# EAGLE schematic MCS (EAGLE 6.5.0)

## Sheet 1 of 3
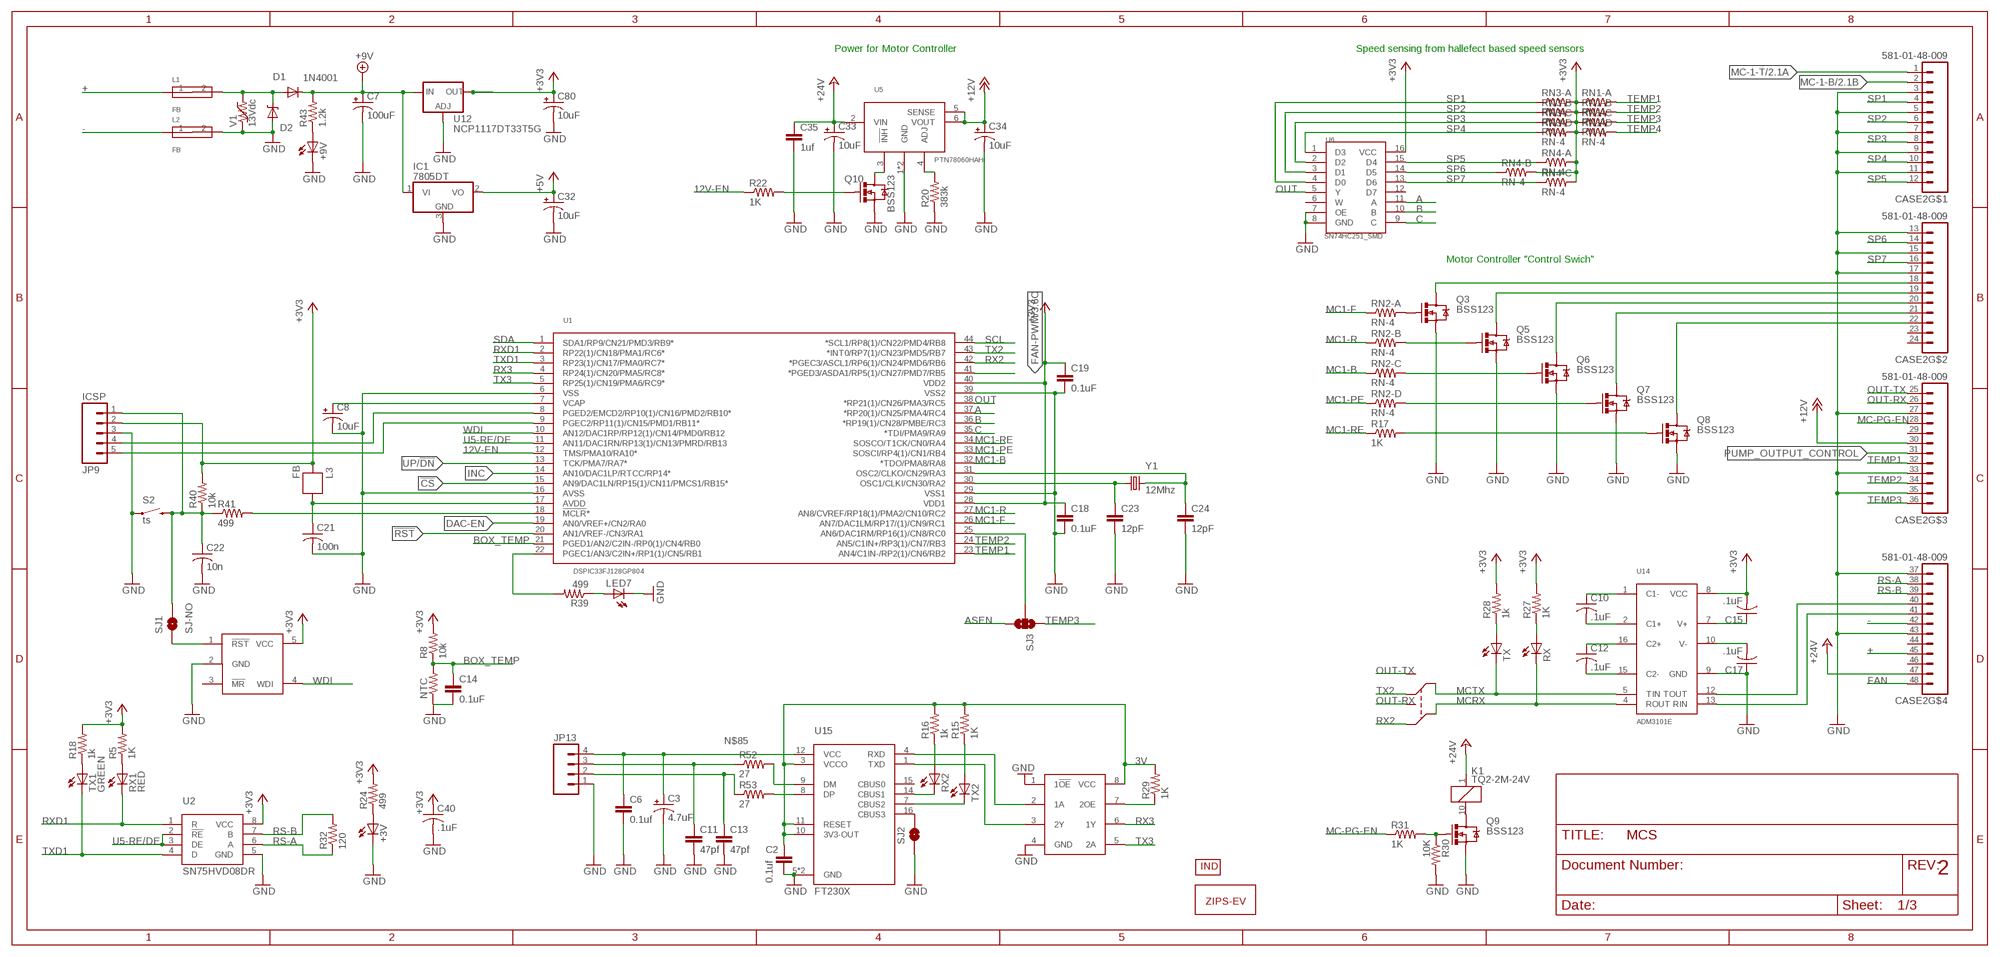
[diagram p0: schematic, sheet 1]

### Parts
+3V  LEDCHIP-LED0805  [CHIP-LED0805]
+9V  LEDCHIP-LED0805  [CHIP-LED0805]
C2  0.1uf  CAP0805  [0805]
C3  4.7uF  CAP_POL1206  [EIA3216]
C6  0.1uf  CAP0805  [0805]
C7  100uF  CAP_POL7343  [EIA7343]
C8  10uF  10UF-TANT  [EIA3216]
C10  .1uF  C-USC0805  [C0805]
C11  47pf  CAP0805  [0805]
C12  .1uF  C-USC0805  [C0805]
C13  47pf  CAP0805  [0805]
C14  0.1uF  CAP0805  [0805]
C15  .1uF  C-USC0805  [C0805]
C17  .1uF  C-USC0805  [C0805]
C18  0.1uF  CAP0805  [0805]
C19  0.1uF  CAP0805  [0805]
C21  100n  C-USC0805  [C0805]
C22  10n  C-USC0805  [C0805]
C23  12pF  CAP0805  [0805]
C24  12pF  CAP0805  [0805]
C32  10uF  POLCAP  [POLC1206]
C33  10uF  POLCAP  [POLC1206]
C34  10uF  POLCAP  [POLC1206]
C35  1uf  CAP1210  [1210]
C40  .1uF  C-USC0805  [C0805]
C80  10uF  POLCAP  [POLC1206]
CASE2  581-01-48-009  [581-01-48-009]
D1  1N4001  DIODE-SOD123  [SOD123]
D2  MM5Z30  [SOD-523F]
IC1  7805DT  [TO252]
JP9  ICSP  M05LOCK_LONGPADS  [1X05_LOCK_LONGPADS]
JP13  M04POLAR_LOCK  [MOLEX-1X4_LOCK]
K1  TQ2-2M-24V  [TQ2-2M-24V]
L1  FB  FERITEBEAD  [0603]
L2  FB  FERITEBEAD  [0603]
L3  FB  [0603]
LED7  LEDCHIP-LED0805  [CHIP-LED0805]
NTC  RESISTOR0805-RES  [0805]
Q3  BSS123  MOSFET-NCHANNELBSS123LT1G  [SOT23-3]
Q5  BSS123  MOSFET-NCHANNELBSS123LT1G  [SOT23-3]
Q6  BSS123  MOSFET-NCHANNELBSS123LT1G  [SOT23-3]
Q7  BSS123  MOSFET-NCHANNELBSS123LT1G  [SOT23-3]
Q8  BSS123  MOSFET-NCHANNELBSS123LT1G  [SOT23-3]
Q9  BSS123  MOSFET-NCHANNELBSS123LT1G  [SOT23-3]
Q10  BSS123  MOSFET-NCHANNELBSS123LT1G  [SOT23-3]
R5  1K  R-US_R0805  [R0805]
R8  10k  RESISTOR0805-RES  [0805]
R15  1K  R-US_R0805  [R0805]
R16  1k  R-US_R0805  [R0805]
R17  1K  R-US_R0805  [R0805]
R18  1k  R-US_R0805  [R0805]
R20  383k  R-US_R0805  [R0805]
R22  1K  R-US_R0805  [R0805]
R24  499  R-US_R0805  [R0805]
R27  1K  R-US_R0805  [R0805]
R28  1k  R-US_R0805  [R0805]
R29  1K  R-US_R0805  [R0805]
R30  10K  R-US_R0805  [R0805]
R31  1K  R-US_R0805  [R0805]
R32  120  R-US_R0805  [R0805]
R39  499  RESISTOR0805-RES  [0805]
R40  10k  RESISTOR0805-RES  [0805]
R41  499  RESISTOR0805-RES  [0805]
R43  1.2k  R-US_R0805  [R0805]
R52  27  RESISTOR0805-RES  [0805]
R53  27  RESISTOR0805-RES  [0805]
RN1  RN-4  [CRA06S]
RN2  RN-4  [CRA06S]
RN3  RN-4  [CRA06S]
RN4  RN-4  [CRA06S]
RX  LEDCHIPLED_0805  [CHIPLED_0805]
RX1  RED  LEDCHIPLED_0805  [CHIPLED_0805]
RX2  LEDCHIPLED_0805  [CHIPLED_0805]
S2  ts  SWITCH-MOMENTARY-2PTH  [TACTILE-PTH]
SJ1  SJ-NO  SOLDERJUMPERNO  [SJ_2S-NO]
SJ2  JUMPER-PAD-2-NOYES_SILK  [PAD-JUMPER-2-NO_YES_SILK]
SJ3  JUMPER-PAD-3-NOFULL_BOX_SILK  [PAD-JUMPER-3-NO_YES_SILK_FULL_BOX]
TX  LEDCHIPLED_0805  [CHIPLED_0805]
TX1  GREEN  LEDCHIPLED_0805  [CHIPLED_0805]
TX2  LEDCHIPLED_0805  [CHIPLED_0805]
U1  DSPIC33FJ128GP804  [TQFP-44]
U2  SN75HVD08DR  [SO-8]
U4  SN74LVC2G241DCTR  [VFSOP-8]
U5  PTN78060HAH  [PTN78060HAH]
U6  SN74HC251_SMD  [SO016]
U9  MAX823  [SOT23-5L]
U12  NCP1117DT33T5G  V_REG_317DPACK  [V-REG_DPACK]
U14  ADM3101E  [SSOP-16]
U15  FT230X  [SSOP-16]
U$1  LOGOM  [L-M]
U$2  INDPK1  [PICKIT-PIN-1]
V1  13Vdc  VAR-RES  [0603]
Y1  12Mhz  CRYSTAL5X3  [CRYSTAL-SMD-5X3]

### Nets
3V: C2.1 R15.2 R16.2 R29.2 U4.8(VCC) U15.3(VCCO) U15.10(3V3-OUT) U15.11(RESET)
12V-EN: R22.1 U1.12(TMS/PMA10/RA10*)
!CS: U1.15(AN9/DAC1LN/RP15(1)/CN11/PMCS1/RB15*) ; also sheet 3
!RST: U1.20(AN1/VREF-/CN3/RA1) ; also sheet 3
+: CASE2.45 L1.1
+3V3: C15.2 C18.1 C19.1 C40.1 C80.1(+) JP9.2 L3.2 R5.2 R8.2 R18.2 R24.2 R27.2 R28.2 R40.2 RN1.1 RN1.2 RN1.3 RN1.4 RN3.5 RN3.6 RN3.7 RN3.8 RN4.6 RN4.7 RN4.8 U1.28(VDD1) U1.40(VDD2) U2.8(VCC) U6.16(VCC) U9.5(VCC) U12.4(OUT) U14.8(VCC) ; also sheet 2
+5V: C32.1(+) IC1.2(VO) ; also sheet 2,3
+9V: C7.A(+) D1.C IC1.1(VI) R43.2 U12.3(IN)
+12V: C34.1(+) CASE2.30 U5.5(SENSE) U5.6(VOUT)
+24V: C33.1(+) C35.1 CASE2.47 K1.1(+) U5.2(VIN) ; also sheet 2,3
-: CASE2.42 L2.1
A: U1.37(*RP20(1)/CN25/PMA4/RC4) U6.11(A) ; also sheet 3
ASEN: SJ3.3 ; also sheet 3
B: U1.36(*RP19(1)/CN28/PMBE/RC3) U6.10(B) ; also sheet 3
BOX_TEMP: C14.1 NTC.2 R8.1 U1.21(PGED1/AN2/C2IN-/RP0(1)/CN4/RB0)
C: U1.35(*TDI/PMA9/RA9) U6.9(C) ; also sheet 3
DAC-EN: U1.19(AN0/VREF+/CN2/RA0) ; also sheet 2
FAN: CASE2.48 ; also sheet 3
FAN-PWM: U1.41(*PGED3/ASDA1/RP5(1)/CN27/PMD7/RB5) ; also sheet 3
GND: +3V.C +9V.C C2.2 C3.C(-) C6.2 C7.C(-) C8.C(-) C11.2 C13.2 C14.2 C17.1 C18.2 C19.2 C21.2 C22.2 C23.2 C24.2 C32.2(-) C33.2(-) C34.2(-) C35.2 C40.2 C80.2(-) CASE2.3 CASE2.5 CASE2.7 CASE2.9 CASE2.11 CASE2.13 CASE2.15 CASE2.17 CASE2.27 CASE2.33 CASE2.35 CASE2.37 CASE2.43 D2.A IC1.3(GND) JP9.3 JP13.1 L2.2 LED7.C NTC.1 Q3.2(S) Q5.2(S) Q6.2(S) Q7.2(S) Q8.2(S) Q9.2(S) Q10.2(S) R20.1 R30.2 S2.1 SJ2.1 U1.6(VSS) U1.16(AVSS) U1.29(VSS1) U1.39(VSS2) U2.5(GND) U4.1(1!OE) U4.4(GND) U5.1(GND) U5.7(GND) U6.7(OE) U6.8(GND) U9.2(GND) U12.1(ADJ) U14.9(GND) U15.5(GND) U15.13(GND) V1.1 ; also sheet 2,3
INC: U1.14(AN10/DAC1LP/RTCC/RP14*) ; also sheet 3
MC1-B: RN2.3 U1.32(*TDO/PMA8/RA8)
MC1-F: RN2.1 U1.26(AN7/DAC1LM/RP17/(1)/CN9/RC1)
MC1-PE: RN2.4 U1.33(SOSCI/RP4(1)/CN1/RB4)
MC1-R: RN2.2 U1.27(AN8/CVREF/RP18(1)/PMA2/CN10/RC2)
MC1-RE: R17.1 U1.34(SOSCO/T1CK/CN0/RA4)
MC-1-B: CASE2.2 ; also sheet 2
MC-1-T: CASE2.1 ; also sheet 2
MC-PG-EN: CASE2.28 R31.1
MCRX: K1.3(C1) RX.C U14.4(ROUT)
MCTX: K1.8(C2) TX.C U14.5(TIN)
N$1: C22.1 JP9.1 R40.1 R41.1 S2.3 SJ1.2
N$2: C21.1 L3.1 U1.17(AVDD)
N$4: C8.A(+) U1.7(VCAP)
N$5: R39.2 U1.22(PGEC1/AN3/C2IN+/RP1(1)/CN5/RB1)
N$6: +9V.A R43.1
N$7: Q3.1(G) RN2.8
N$8: R41.2 U1.18(!MCLR!*)
N$9: CASE2.18 Q3.3(D)
N$10: SJ1.1 U9.1(!RST)
N$11: R15.1 TX2.A
N$12: JP9.4 U1.8(PGED2/EMCD2/RP10(1)/CN16/PMD2/RB10*)
N$13: TX2.C U15.7(CBUS2)
N$14: RX2.C U15.14(CBUS1)
N$15: JP9.5 U1.9(PGEC2/RP11(1)/CN15/PMD1/RB11*)
N$16: R16.1 RX2.A
N$19: U4.2(1A) U15.4(RXD)
N$20: Q5.1(G) RN2.7
N$25: +3V.A R24.1
N$26: CASE2.19 Q5.3(D)
N$27: U4.3(2Y) U15.1(TXD)
N$28: R52.2 U15.9(DM)
N$29: Q6.1(G) RN2.6
N$30: CASE2.20 Q6.3(D)
N$31: R18.1 TX1.A
N$32: R5.1 RX1.A
N$33: SJ3.2 U1.25(AN6/DAC1RM/RP16(1)/CN8/RC0)
N$35: Q8.1(G) R17.2
N$37: LED7.A R39.1
N$39: C24.1 U1.31(OSC2/CLKO/CN29/RA3) Y1.3
N$40: C23.1 U1.30(OSC1/CLKI/CN30/RA2) Y1.1
N$54: R53.2 U15.8(DP)
N$55: C11.1 JP13.3 R52.1
N$59: C10.1 U14.1(C1-)
N$61: C13.1 JP13.2 R53.1
N$62: SJ2.2 U15.16(CBUS3)
N$63: D1.A D2.C L1.2 V1.2
N$65: C10.2 U14.2(C1+)
N$66: C12.1 U14.16(C2+)
N$67: C12.2 U14.15(C2-)
N$68: C15.1 U14.7(V+)
N$69: R29.1 U4.7(2OE)
N$70: CASE2.21 Q7.3(D)
N$71: CASE2.22 Q8.3(D)
N$72: C17.2 U14.10(V-)
N$73: CASE2.40 U14.12(TOUT)
N$74: CASE2.41 U14.13(RIN)
N$75: R27.1 RX.A
N$76: R28.1 TX.A
N$77: K1.10(-) Q9.3(D)
N$78: Q9.1(G) R30.1 R31.2
N$79: R20.2 U5.4(ADJ)
N$80: Q10.3(D) U5.3(!INH)
N$81: Q7.1(G) RN2.5
N$82: Q10.1(G) R22.2
N$85: C3.A(+) C6.1 JP13.4 U15.12(VCC)
OUT: U1.38(*RP21(1)/CN26/PMA3/RC5) U6.5(Y)
OUT-RX: CASE2.26 K1.4(NO1)
OUT-TX: CASE2.25 K1.7(NO2)
PUMP_OUTPUT_CONTROL: CASE2.31 ; also sheet 3
RS-A: CASE2.38 R32.1 U2.6(A)
RS-B: CASE2.39 R32.2 U2.7(B)
RX2: K1.2(NC1) U1.42(*PGEC3/ASCL1/RP6(1)/CN24/PMD6/RB6)
RX3: U1.4(RP24(1)/CN20/PMA5/RC8*) U4.6(1Y)
RXD1: RX1.C U1.2(RP22(1)/CN18/PMA1/RC6*) U2.1(R)
SCL: U1.44(*SCL1/RP8(1)/CN22/PMD4/RB8) ; also sheet 2
SDA: U1.1(SDA1/RP9/CN21/PMD3/RB9*) ; also sheet 2
SP1: CASE2.4 RN3.1 U6.4(D0)
SP2: CASE2.6 RN3.2 U6.3(D1)
SP3: CASE2.8 RN3.3 U6.2(D2)
SP4: CASE2.10 RN3.4 U6.1(D3)
SP5: CASE2.12 RN4.1 U6.15(D4)
SP6: CASE2.14 RN4.2 U6.14(D5)
SP7: CASE2.16 RN4.3 U6.13(D6)
TEMP1: CASE2.32 RN1.8 U1.23(AN4/C1IN-/RP2(1)/CN6/RB2)
TEMP2: CASE2.34 RN1.7 U1.24(AN5/C1IN+/RP3(1)/CN7/RB3)
TEMP3: CASE2.36 RN1.6 SJ3.1
TEMP4: RN1.5
TX2: K1.9(NC2) U1.43(*INT0/RP7(1)/CN23/PMD5/RB7)
TX3: U1.5(RP25(1)/CN19/PMA6/RC9*) U4.5(2A)
TXD1: TX1.C U1.3(RP23(1)/CN17/PMA0/RC7*) U2.4(D)
U5-RE/DE: U1.11(AN11/DAC1RN/RP13(1)/CN13/PMRD/RB13) U2.2(!RE) U2.3(DE)
UP/!DN: U1.13(TCK/PMA7/RA7*) ; also sheet 3
WDI: U1.10(AN12/DAC1RP/RP12(1)/CN14/PMD0/RB12) U9.4(WDI)
Unconnected: CASE2.23 CASE2.24 CASE2.29 CASE2.44 CASE2.46 RN4.4 RN4.5 U6.6(W) U6.12(D7) U9.3(!MR) U15.15(CBUS0)

### Notes on the sheet
- Power for Motor Controller | Speed sensing from hallefect based speed sensors
- Motor Controller "Control Swich"
- 2

## Sheet 2 of 3
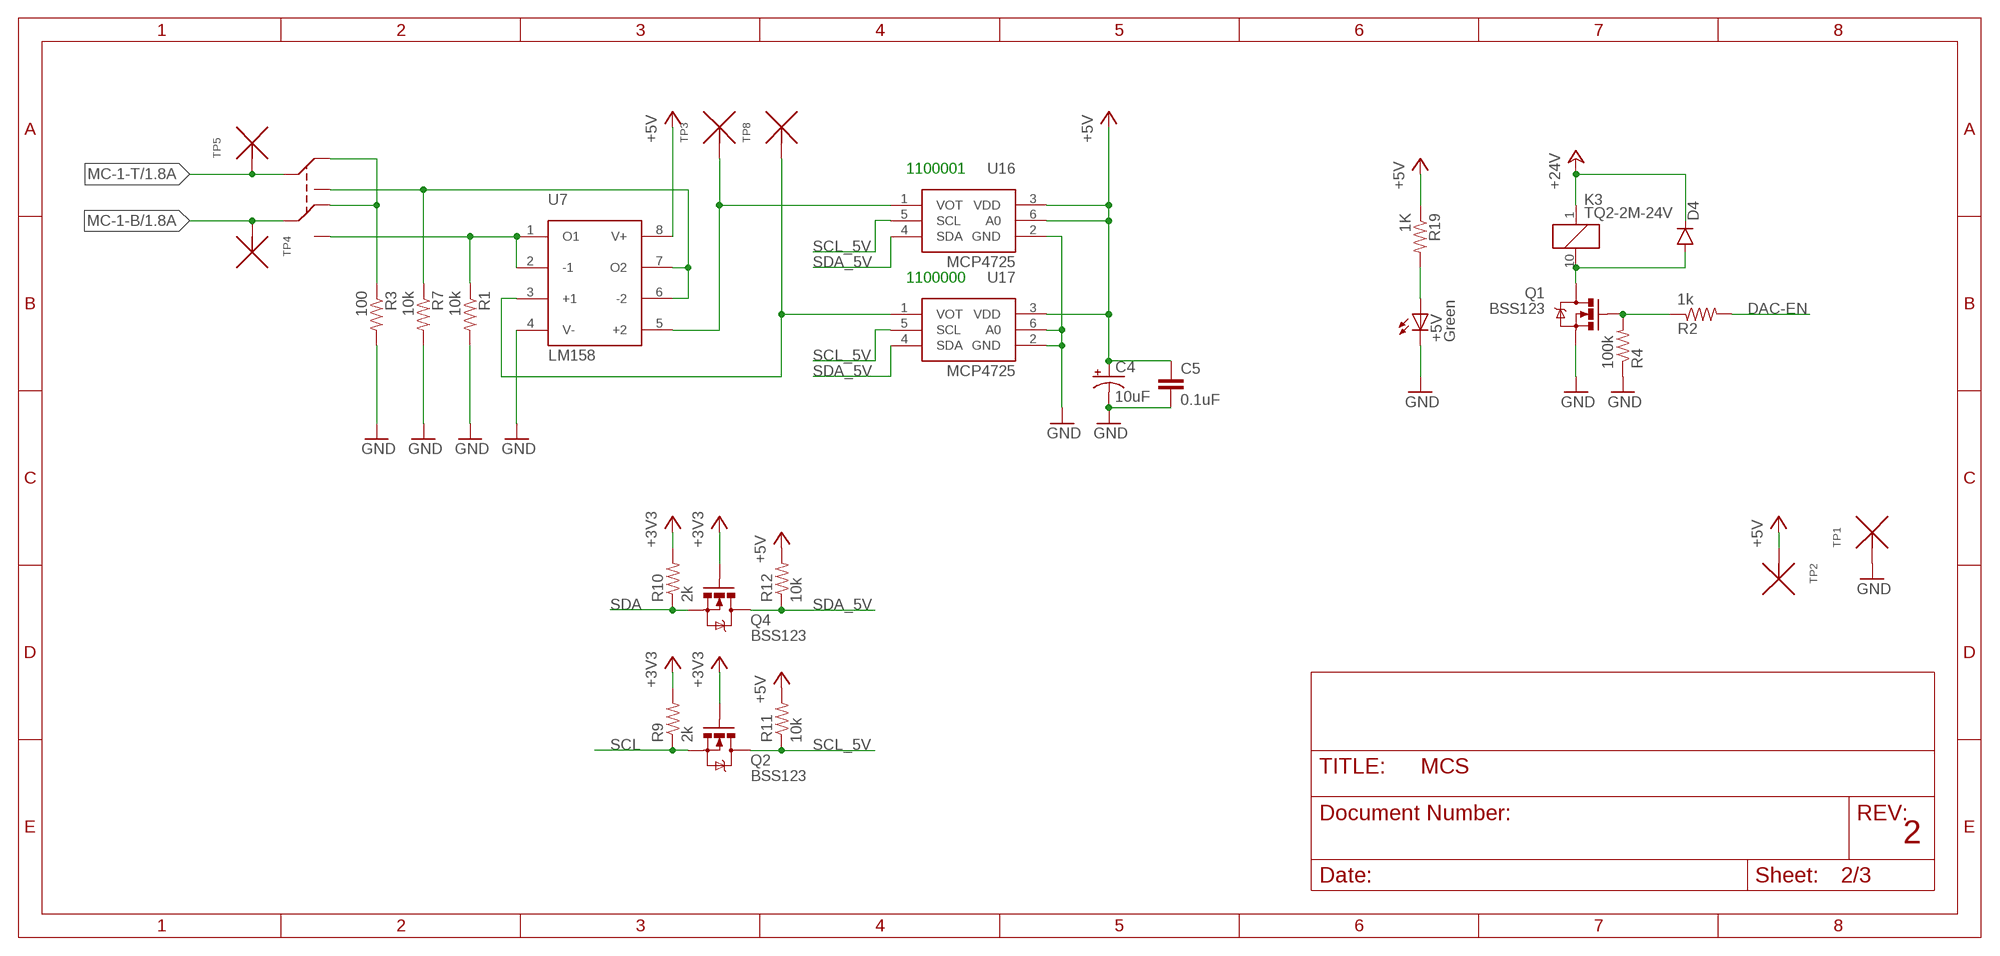
[diagram p1: schematic, sheet 2]

### Parts
+5V  Green  LEDCHIPLED_0805  [CHIPLED_0805]
C4  10uF  10UF-16V-10%(TANT)  [EIA3216]
C5  0.1uF  CAP0805  [0805]
D4  DIODESMA-ALT  [SMA-DIODE_ALT]
K3  TQ2-2M-24V  [TQ2-2M-24V]
Q1  BSS123  MOSFET-NCHANNELBSS138  [SOT23-3]
Q2  BSS123  MOSFET-NCHANNELBSS123LT1G  [SOT23-3]
Q4  BSS123  MOSFET-NCHANNELBSS123LT1G  [SOT23-3]
R1  10k  RESISTOR0805-RES  [0805]
R2  1k  RESISTOR0805-RES  [0805]
R3  100  RESISTOR0805-RES  [0805]
R4  100k  RESISTOR0805-RES  [0805]
R7  10k  RESISTOR0805-RES  [0805]
R9  2k  RESISTOR0805-RES  [0805]
R10  2k  RESISTOR0805-RES  [0805]
R11  10k  RESISTOR0805-RES  [0805]
R12  10k  RESISTOR0805-RES  [0805]
R19  1K  R-US_M0805  [M0805]
TP1  TESTPOINT  [4952]
TP2  TESTPOINT  [4952]
TP3  TESTPOINT  [4952]
TP4  TESTPOINT  [4952]
TP5  TESTPOINT  [4952]
TP8  TESTPOINT  [4952]
U7  LM158  [TSSOP-08]
U16  MCP4725  [SOT23-6]
U17  MCP4725  [SOT23-6]

### Nets
+3V3: Q2.1(G) Q4.1(G) R9.2 R10.2 ; also sheet 1
+5V: C4.A(+) C5.1 R11.2 R12.2 R19.1 TP2.P$1(TP) U7.8(V+) U16.3(VDD) U16.6(A0) U17.3(VDD) ; also sheet 1,3
+24V: D4.C K3.1(+) ; also sheet 1,3
DAC-EN: R2.2 ; also sheet 1
GND: +5V.C C4.C(-) C5.2 Q1.2(S) R1.2 R3.2 R4.1 R7.2 TP1.P$1(TP) U7.4(V-) U16.2(GND) U17.2(GND) U17.6(A0) ; also sheet 1,3
MC-1-B: K3.8(C2) TP4.P$1(TP) ; also sheet 1
MC-1-T: K3.3(C1) TP5.P$1(TP) ; also sheet 1
N$3: K3.7(NO2) R1.1 U7.1(O1) U7.2(-1)
N$17: TP3.P$1(TP) U7.5(+2) U16.1(VOT)
N$18: K3.4(NO1) R7.1 U7.6(-2) U7.7(O2)
N$21: K3.2(NC1) K3.9(NC2) R3.1
N$22: TP8.P$1(TP) U7.3(+1) U17.1(VOT)
N$41: +5V.A R19.2
N$42: Q1.1(G) R2.1 R4.2
N$43: D4.A K3.10(-) Q1.3(D)
SCL: Q2.2(S) R9.1 ; also sheet 1
SCL_5V: Q2.3(D) R11.1 U16.5(SCL) U17.5(SCL)
SDA: Q4.2(S) R10.1 ; also sheet 1
SDA_5V: Q4.3(D) R12.1 U16.4(SDA) U17.4(SDA)

### Notes on the sheet
- 1100001
- 1100000
- 2

## Sheet 3 of 3
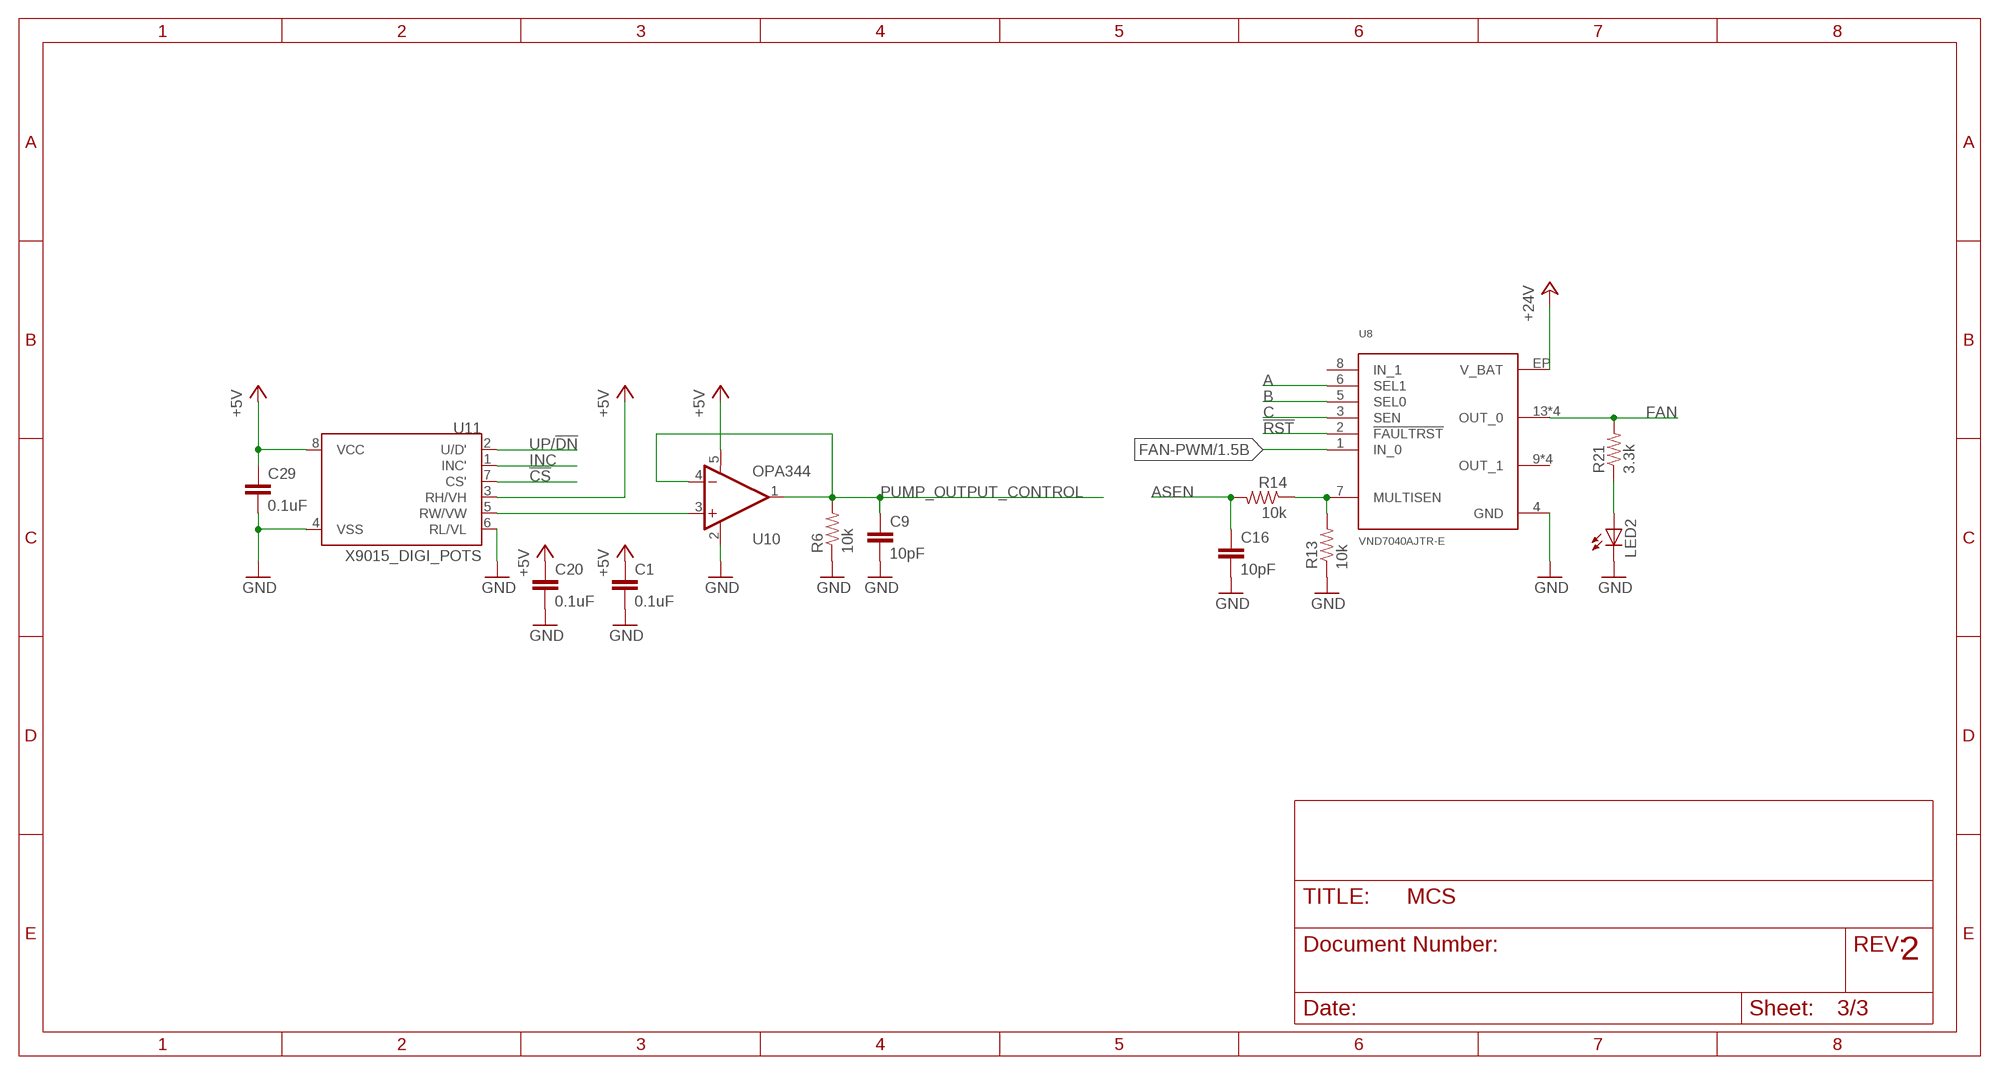
[diagram p2: schematic, sheet 3]

### Parts
C1  0.1uF  CAP0805  [0805]
C9  10pF  CAP0805  [0805]
C16  10pF  CAP0805  [0805]
C20  0.1uF  CAP0805  [0805]
C29  0.1uF  CAP0805  [0805]
LED2  LEDCHIP-LED0805  [CHIP-LED0805]
R6  10k  RESISTOR0805-RES  [0805]
R13  10k  RESISTOR0805-RES  [0805]
R14  10k  RESISTOR0805-RES  [0805]
R21  3.3k  RESISTOR0805-RES  [0805]
U8  VND7040AJTR-E  [SSO-16-POWER]
U10  OPA344  [SOT23-5]
U11  X9015_DIGI_POTS  [SO08]

### Nets
!CS: U11.7(CS') ; also sheet 1
!RST: U8.2(!FAULTRST) ; also sheet 1
+5V: C1.1 C20.1 C29.1 U10.5(V+) U11.3(RH/VH) U11.8(VCC) ; also sheet 1,2
+24V: U8.EP(V_BAT) ; also sheet 1,2
A: U8.6(SEL1) ; also sheet 1
ASEN: C16.1 R14.2 ; also sheet 1
B: U8.5(SEL0) ; also sheet 1
C: U8.3(SEN) ; also sheet 1
FAN: R21.2 U8.13(OUT_0) U8.14(OUT_0) U8.15(OUT_0) U8.16(OUT_0) ; also sheet 1
FAN-PWM: U8.1(IN_0) ; also sheet 1
GND: C1.2 C9.2 C16.2 C20.2 C29.2 LED2.C R6.1 R13.1 U8.4(GND) U10.2(V-) U11.4(VSS) U11.6(RL/VL) ; also sheet 1,2
INC: U11.1(INC') ; also sheet 1
N$23: LED2.A R21.1
N$24: U10.3(+IN) U11.5(RW/VW)
N$45: R13.2 R14.1 U8.7(MULTISEN)
PUMP_OUTPUT_CONTROL: C9.1 R6.2 U10.1(OUT) U10.4(-IN) ; also sheet 1
UP/!DN: U11.2(U/D') ; also sheet 1
Unconnected: U8.8(IN_1) U8.9(OUT_1) U8.10(OUT_1) U8.11(OUT_1) U8.12(OUT_1)

### Notes on the sheet
- 2

## Library data of the parts
+3V +5V +9V LED2 LED7 RX RX1 RX2 TX TX1 TX2 = adafruit:LED: LED OSRAM: - CHIPLED LG R971, LG N971, LY N971, LG Q971, LY Q971, LO R971, LY R971 LH N974, LH R974 LS Q976, LO Q976, LY Q976 LO Q996 - Hyper CHIPLED LW Q18S LB Q993, LB Q99A, LB R99A - SideLED LS A670, LO A670, LY A670, LG A670, LP A670 LB A673, LV A673, LT A673, LW A673 LH A674 LY A675 LS A676, LA A676, LO A676, LY A676, LW A676 LS A679, LY A679, LG A679 - Hyper Micro SIDELED® LS Y876, LA Y876, LO Y876, LY Y876 LT Y87S - SmartLED LW L88C, LW L88S LB L89C, LB L89S, LG L890 LS L89K, LO L89K, LY L89K LS L896, LA L896, LO L896, LY L896 - TOPLED LS T670, LO T670, LY T670, LG T670, LP T670 LSG T670, LSP T670, LSY T670, LOP T670, LYG T670 LG T671, LOG T671, LSG T671 LB T673, LV T673, LT T673, LW T673 LH T674 LS T676, LA T676, LO T676, LY T676, LB T676, LH T676, LSB T676, LW T676 LB T67C, LV T67C, LT T67C, LS T67K, LO T67K, LY T67K, LW E67C LS E67B, LA E67B, LO E67B, LY E67B, LB E67C, LV E67C, LT E67C LW T67C LS T679, LY T679, LG T679 LS T770, LO T770, LY T770, LG T770, LP T770 LB T773, LV T773, LT T773, LW T773 LH T774 LS E675, LA E675, LY E675, LS T675 LS T776, LA T776, LO T776, LY T776, LB T776 LHGB T686 LT T68C, LB T68C - Hyper Mini TOPLED® LB M676 - Mini TOPLED Santana® LG M470 LS M47K, LO M47K, LY M47K Source: http://www.osram.convergy.de/
C1 C5 C9 C16 C20 C29 = SparkFun-Passives:CAP: Capacitor Standard 0603 ceramic capacitor, and 0.1" leaded capacitor.
C2 C6 C11 C13 = SparkFun:CAP: Capacitor Standard 0603 ceramic capacitor, and 0.1" leaded capacitor.
C3 = SparkFun:CAP_POL: Capacitor Polarized These are standard SMD and PTH capacitors. Normally 10uF, 47uF, and 100uF in electrolytic and tantalum varieties. Always verify the external diameter of the through hole cap, it varies with capacity, voltage, and manufacturer. The EIA devices should be standard.
C4 = SparkFun-Capacitors:10UF-16V-10%(TANT): CAP-00811 1206/EIA-3216 Tantalum capacitor; PROD_ID: CAP-00811
C7 = SparkFun-Capacitors:CAP_POL: Capacitor Polarized These are standard SMD and PTH capacitors. Normally 10uF, 47uF, and 100uF in electrolytic and tantalum varieties. Always verify the external diameter of the through hole cap, it varies with capacity, voltage, and manufacturer. The EIA devices should be standard.
C8 = SparkFun-Capacitors:10UF-TANT: 10uF Tantalum SMT CAP-00811- 16V 10% (EIA-3216); PROD_ID: CAP-00811
C10 C12 C15 C17 C21 C22 C40 = adafruit:C-US: CAPACITOR, American symbol
C14 C18 C19 C23 C24 C35 = SparkFun-Capacitors:CAP: Capacitor Standard 0603 ceramic capacitor, and 0.1" leaded capacitor.
C32-C34 C80 = RJ's_parts:POLCAP
CASE2 = FSAE Eletric:581-01-48-009
D1 = diode:DIODE-: DIODE
D2 = EmEndev:MM5Z30
D4 = SparkFun-DiscreteSemi:DIODE: Diode These are standard reverse protection diodes and small signal diodes. SMA package can handle up to about 1A. SOD-323 can handle about 200mA. What the SOD-323 package when ordering, there are some mfgs out there that are 5-pin packages.
IC1 = adafruit:78*: Positive VOLTAGE REGULATOR Added bigger pads to the TO-92 package
JP9 = SparkFun-Connectors:M05: Header 5 Standard 5-pin 0.1" header. Use with straight break away headers (SKU : PRT-00116), right angle break away headers (PRT-00553), swiss pins (PRT-00743), machine pins (PRT-00117), and female headers (PRT-00115). Molex polarized connector foot print use with SKU : PRT-08230 with associated crimp pins and housings.
JP13 = SparkFun-Connectors:M04: Header 4 Standard 4-pin 0.1" header. Use with straight break away headers (SKU : PRT-00116), right angle break away headers (PRT-00553), swiss pins (PRT-00743), machine pins (PRT-00117), and female headers (PRT-00115). Molex polarized connector foot print use with SKU : PRT-08231 with associated crimp pins and housings. 1MM SMD Version SKU: PRT-10208
K1 K3 = FSAE Eletric:TQ2-2M-24V
L1 L2 = EmEndev:FERITEBEAD
L3 = SparkFun-Passives:FB
NTC R1-R4 R6-R14 R21 R39 R40 R52 R53 = SparkFun-Passives:RESISTOR: Resistor Basic schematic elements and footprints for 0603, 1206, and PTH resistors.
Q1 = SparkFun-DiscreteSemi:MOSFET-NCHANNEL: Common NMOSFET Parts MFG P/NStore IDProd ID FDD8780TRANS-09984 SI7820DNTRANS-11055 FDS6630AIC-08089 2N7002PWTRANS-11151 FQP30N06L COM-10213TRANS-10060 BSS123LT1GTRANS-08345 BSS138TRANS-00830 BS170 2N7000; PROD_ID: TRANS-00830; VALUE: 200mA/50V
Q2-Q10 = SparkFun-DiscreteSemi:MOSFET-NCHANNEL: Common NMOSFET Parts MFG P/NStore IDProd ID FDD8780TRANS-09984 SI7820DNTRANS-11055 FDS6630AIC-08089 2N7002PWTRANS-11151 FQP30N06L COM-10213TRANS-10060 BSS123LT1GTRANS-08345 BSS138TRANS-00830 BS170 2N7000; PROD_ID: TRANS-08345
R5 R15-R20 R22 R24 R27-R32 R43 = adafruit:R-US_: RESISTOR, American symbol
R41 = SparkFun-Resistors:RESISTOR: Resistor Basic schematic elements and footprints for 0603, 1206, and PTH resistors.
RN1-RN4 = DFT2:RN-4
S2 = SparkFun-Electromechanical:SWITCH-MOMENTARY-2: Various NO switches- pushbuttons, reed, etc
SJ1 = SparkFun-Passives:SOLDERJUMPER: Solder Jumper Standard SMD solder jumper. Used to automate production. Two varients : Normally Open and Normally Closed are the same, but have different paste layers. NC will have a large amount of paste and should jumper during reflow.
SJ2 = SparkFun-Passives:JUMPER-PAD-2-NO
SJ3 = SparkFun-Passives:JUMPER-PAD-3-NO
TP1-TP5 TP8 = Gilson:TESTPOINT
U1 = FSAE Eletric:DSPIC33FJ128GP804
U2 = FSAE Eletric:SN75HVD08DR
U4 = Cleaverbrooks:SN74LVC2G241DCTR
U5 = FSAE Eletric:PTN78060HAH
U6 = SparkFun-DigitalIC:SN74HC251: SN54HC251 Data Selector/Multiplexer
U7 = DSL:LM158
U8 = FSAE Eletric:VND7040AJTR-E
U9 = NASA_LIB:MAX823
U10 = SparkFun-AnalogIC:OPA344: Single gate rail-to-rail output op-amp. Inputs extend 300mV past rails.
U11 = SparkFun-AnalogIC:X9015_DIGI_POT: Digital pot- up/down/increment control only
U12 = SparkFun-PowerIC:V_REG_317: Voltage Regulator Standard LM317 adjustable voltage regulator. AOI (Adjust Output Input). Google 'LM317 Calculator' for easy to use app to get the two resistor values needed. 240/720 for 5V output. 240/390 for 3.3V output. Spark Fun Electronics SKU : COM-00527
U14 = FSAE Eletric:ADM3101E
U15 = FSAE Eletric:FT230X
U16 U17 = FSAE Eletric:MCP4725
U$1 = Pic:LOGO
U$2 = FSAE Eletric:IND
V1 = EmEndev:VAR-RES
Y1 = SparkFun-FreqCtrl:CRYSTAL: Various standard crystals. Proven footprints. Spark Fun Electronics SKU : COM-00534